# EAGLE schematic Resistor_Resistor (EAGLE 8.3.0), part 31 of 43
## Nets (continued)
N$37: R6001.2 R6002.2 R6003.2 R6004.2 R6005.2 R6006.2 R6007.2 R6008.2 R6009.2 R6010.2 R6011.2 R6012.2 R6013.2 R6014.2 R6015.2 R6016.2 R6017.2 R6018.2 R6019.2 R6020.2 R6021.2 R6022.2 R6023.2 R6024.2 R6025.2 R6026.2 R6027.2 R6028.2 R6029.2 R6030.2 R6031.2 R6032.2 R6033.2 R6034.2 R6035.2 R6036.2 R6037.2 R6038.2 R6039.2 R6040.2 R6041.2 R6042.2 R6043.2 R6044.2 R6045.2 R6046.2 R6047.2 R6048.2 R6049.2 R6050.2 R6051.2 R6052.2 R6053.2 R6054.2 R6055.2 R6056.2 R6057.2 R6058.2 R6059.2 R6060.2 R6061.2 R6062.2 R6063.2 R6064.2 R6065.2 R6066.2 R6067.2 R6068.2 R6069.2 R6070.2 R6071.2 R6072.2 R6073.2 R6074.2 R6075.2 R6076.2 R6077.2 R6078.2 R6079.2 R6080.2 R6081.2 R6082.2 R6083.2 R6084.2 R6085.2 R6086.2 R6087.2 R6088.2 R6089.2 R6090.2 R6091.2 R6092.2 R6093.2 R6094.2 R6095.2 R6096.2 R6097.2 R6098.2 R6099.2 R6100.2 R6101.2 R6102.2 R6103.2 R6104.2 R6105.2 R6106.2 R6107.2 R6108.2 R6109.2 R6110.2 R6111.2 R6112.2 R6113.2 R6114.2 R6115.2 R6116.2 R6117.2 R6118.2 R6119.2 R6120.2 R6121.2 R6122.2 R6123.2 R6124.2 R6125.2 R6126.2 R6127.2 R6128.2 R6129.2 R6130.2 R6131.2 R6132.2 R6133.2 R6134.2 R6135.2 R6136.2 R6137.2 R6138.2 R6139.2 R6140.2 R6141.2 R6142.2 R6143.2 R6144.2 R6145.2 R6146.2 R6147.2 R6148.2 R6149.2 R6150.2 R6151.2 R6152.2 R6153.2 R6154.2 R6155.2 R6156.2 R6157.2 R6158.2 R6159.2 R6160.2 R6161.2 R6162.2 R6163.2 R6164.2 R6165.2 R6166.2 R6167.2 R6168.2 R6169.2 R6170.2 R6171.2 R6172.2 R6173.2 R6174.2 R6175.2 R6176.2 R6177.2 R6178.2 R6179.2 R6180.2 R6181.2 R6182.2 R6183.2 R6184.2 R6185.2 R6186.2 R6187.2 R6188.2 R6189.2 R6190.2 R6191.2 R6192.2 R6193.2 R6194.2 R6195.2 R6196.2 R6197.2 R6198.2 R6199.2 R6200.2 R6201.1 R6202.1 R6203.1 R6204.1 R6205.1 R6206.1 R6207.1 R6208.1 R6209.1 R6210.1 R6211.1 R6212.1 R6213.1 R6214.1 R6215.1 R6216.1 R6217.1 R6218.1 R6219.1 R6220.1 R6221.1 R6222.1 R6223.1 R6224.1 R6225.1 R6226.1 R6227.1 R6228.1 R6229.1 R6230.1 R6231.1 R6232.1 R6233.1 R6234.1 R6235.1 R6236.1 R6237.1 R6238.1 R6239.1 R6240.1 R6241.1 R6242.1 R6243.1 R6244.1 R6245.1 R6246.1 R6247.1 R6248.1 R6249.1 R6250.1 R6251.1 R6252.1 R6253.1 R6254.1 R6255.1 R6256.1 R6257.1 R6258.1 R6259.1 R6260.1 R6261.1 R6262.1 R6263.1 R6264.1 R6265.1 R6266.1 R6267.1 R6268.1 R6269.1 R6270.1 R6271.1 R6272.1 R6273.1 R6274.1 R6275.1 R6276.1 R6277.1 R6278.1 R6279.1 R6280.1 R6281.1 R6282.1 R6283.1 R6284.1 R6285.1 R6286.1 R6287.1 R6288.1 R6289.1 R6290.1 R6291.1 R6292.1 R6293.1 R6294.1 R6295.1 R6296.1 R6297.1 R6298.1 R6299.1 R6300.1 R6301.1 R6302.1 R6303.1 R6304.1 R6305.1 R6306.1 R6307.1 R6308.1 R6309.1 R6310.1 R6311.1 R6312.1 R6313.1 R6314.1 R6315.1 R6316.1 R6317.1 R6318.1 R6319.1 R6320.1 R6321.1 R6322.1 R6323.1 R6324.1 R6325.1 R6326.1 R6327.1 R6328.1 R6329.1 R6330.1 R6331.1 R6332.1 R6333.1 R6334.1 R6335.1 R6336.1 R6337.1 R6338.1 R6339.1 R6340.1 R6341.1 R6342.1 R6343.1 R6344.1 R6345.1 R6346.1 R6347.1 R6348.1 R6349.1 R6350.1 R6351.1 R6352.1 R6353.1 R6354.1 R6355.1 R6356.1 R6357.1 R6358.1 R6359.1 R6360.1 R6361.1 R6362.1 R6363.1 R6364.1 R6365.1 R6366.1 R6367.1 R6368.1 R6369.1 R6370.1 R6371.1 R6372.1 R6373.1 R6374.1 R6375.1 R6376.1 R6377.1 R6378.1 R6379.1 R6380.1 R6381.1 R6382.1 R6383.1 R6384.1 R6385.1 R6386.1 R6387.1 R6388.1 R6389.1 R6390.1 R6391.1 R6392.1 R6393.1 R6394.1 R6395.1 R6396.1 R6397.1 R6398.1 R6399.1 R6400.1
N$38: R6201.2 R6202.2 R6203.2 R6204.2 R6205.2 R6206.2 R6207.2 R6208.2 R6209.2 R6210.2 R6211.2 R6212.2 R6213.2 R6214.2 R6215.2 R6216.2 R6217.2 R6218.2 R6219.2 R6220.2 R6221.2 R6222.2 R6223.2 R6224.2 R6225.2 R6226.2 R6227.2 R6228.2 R6229.2 R6230.2 R6231.2 R6232.2 R6233.2 R6234.2 R6235.2 R6236.2 R6237.2 R6238.2 R6239.2 R6240.2 R6241.2 R6242.2 R6243.2 R6244.2 R6245.2 R6246.2 R6247.2 R6248.2 R6249.2 R6250.2 R6251.2 R6252.2 R6253.2 R6254.2 R6255.2 R6256.2 R6257.2 R6258.2 R6259.2 R6260.2 R6261.2 R6262.2 R6263.2 R6264.2 R6265.2 R6266.2 R6267.2 R6268.2 R6269.2 R6270.2 R6271.2 R6272.2 R6273.2 R6274.2 R6275.2 R6276.2 R6277.2 R6278.2 R6279.2 R6280.2 R6281.2 R6282.2 R6283.2 R6284.2 R6285.2 R6286.2 R6287.2 R6288.2 R6289.2 R6290.2 R6291.2 R6292.2 R6293.2 R6294.2 R6295.2 R6296.2 R6297.2 R6298.2 R6299.2 R6300.2 R6301.2 R6302.2 R6303.2 R6304.2 R6305.2 R6306.2 R6307.2 R6308.2 R6309.2 R6310.2 R6311.2 R6312.2 R6313.2 R6314.2 R6315.2 R6316.2 R6317.2 R6318.2 R6319.2 R6320.2 R6321.2 R6322.2 R6323.2 R6324.2 R6325.2 R6326.2 R6327.2 R6328.2 R6329.2 R6330.2 R6331.2 R6332.2 R6333.2 R6334.2 R6335.2 R6336.2 R6337.2 R6338.2 R6339.2 R6340.2 R6341.2 R6342.2 R6343.2 R6344.2 R6345.2 R6346.2 R6347.2 R6348.2 R6349.2 R6350.2 R6351.2 R6352.2 R6353.2 R6354.2 R6355.2 R6356.2 R6357.2 R6358.2 R6359.2 R6360.2 R6361.2 R6362.2 R6363.2 R6364.2 R6365.2 R6366.2 R6367.2 R6368.2 R6369.2 R6370.2 R6371.2 R6372.2 R6373.2 R6374.2 R6375.2 R6376.2 R6377.2 R6378.2 R6379.2 R6380.2 R6381.2 R6382.2 R6383.2 R6384.2 R6385.2 R6386.2 R6387.2 R6388.2 R6389.2 R6390.2 R6391.2 R6392.2 R6393.2 R6394.2 R6395.2 R6396.2 R6397.2 R6398.2 R6399.2 R6400.2 R6401.1 R6402.1 R6403.1 R6404.1 R6405.1 R6406.1 R6407.1 R6408.1 R6409.1 R6410.1 R6411.1 R6412.1 R6413.1 R6414.1 R6415.1 R6416.1 R6417.1 R6418.1 R6419.1 R6420.1 R6421.1 R6422.1 R6423.1 R6424.1 R6425.1 R6426.1 R6427.1 R6428.1 R6429.1 R6430.1 R6431.1 R6432.1 R6433.1 R6434.1 R6435.1 R6436.1 R6437.1 R6438.1 R6439.1 R6440.1 R6441.1 R6442.1 R6443.1 R6444.1 R6445.1 R6446.1 R6447.1 R6448.1 R6449.1 R6450.1 R6451.1 R6452.1 R6453.1 R6454.1 R6455.1 R6456.1 R6457.1 R6458.1 R6459.1 R6460.1 R6461.1 R6462.1 R6463.1 R6464.1 R6465.1 R6466.1 R6467.1 R6468.1 R6469.1 R6470.1 R6471.1 R6472.1 R6473.1 R6474.1 R6475.1 R6476.1 R6477.1 R6478.1 R6479.1 R6480.1 R6481.1 R6482.1 R6483.1 R6484.1 R6485.1 R6486.1 R6487.1 R6488.1 R6489.1 R6490.1 R6491.1 R6492.1 R6493.1 R6494.1 R6495.1 R6496.1 R6497.1 R6498.1 R6499.1 R6500.1 R6501.1 R6502.1 R6503.1 R6504.1 R6505.1 R6506.1 R6507.1 R6508.1 R6509.1 R6510.1 R6511.1 R6512.1 R6513.1 R6514.1 R6515.1 R6516.1 R6517.1 R6518.1 R6519.1 R6520.1 R6521.1 R6522.1 R6523.1 R6524.1 R6525.1 R6526.1 R6527.1 R6528.1 R6529.1 R6530.1 R6531.1 R6532.1 R6533.1 R6534.1 R6535.1 R6536.1 R6537.1 R6538.1 R6539.1 R6540.1 R6541.1 R6542.1 R6543.1 R6544.1 R6545.1 R6546.1 R6547.1 R6548.1 R6549.1 R6550.1 R6551.1 R6552.1 R6553.1 R6554.1 R6555.1 R6556.1 R6557.1 R6558.1 R6559.1 R6560.1 R6561.1 R6562.1 R6563.1 R6564.1 R6565.1 R6566.1 R6567.1 R6568.1 R6569.1 R6570.1 R6571.1 R6572.1 R6573.1 R6574.1 R6575.1 R6576.1 R6577.1 R6578.1 R6579.1 R6580.1 R6581.1 R6582.1 R6583.1 R6584.1 R6585.1 R6586.1 R6587.1 R6588.1 R6589.1 R6590.1 R6591.1 R6592.1 R6593.1 R6594.1 R6595.1 R6596.1 R6597.1 R6598.1 R6599.1 R6600.1
N$40: R6401.2 R6402.2 R6403.2 R6404.2 R6405.2 R6406.2 R6407.2 R6408.2 R6409.2 R6410.2 R6411.2 R6412.2 R6413.2 R6414.2 R6415.2 R6416.2 R6417.2 R6418.2 R6419.2 R6420.2 R6421.2 R6422.2 R6423.2 R6424.2 R6425.2 R6426.2 R6427.2 R6428.2 R6429.2 R6430.2 R6431.2 R6432.2 R6433.2 R6434.2 R6435.2 R6436.2 R6437.2 R6438.2 R6439.2 R6440.2 R6441.2 R6442.2 R6443.2 R6444.2 R6445.2 R6446.2 R6447.2 R6448.2 R6449.2 R6450.2 R6451.2 R6452.2 R6453.2 R6454.2 R6455.2 R6456.2 R6457.2 R6458.2 R6459.2 R6460.2 R6461.2 R6462.2 R6463.2 R6464.2 R6465.2 R6466.2 R6467.2 R6468.2 R6469.2 R6470.2 R6471.2 R6472.2 R6473.2 R6474.2 R6475.2 R6476.2 R6477.2 R6478.2 R6479.2 R6480.2 R6481.2 R6482.2 R6483.2 R6484.2 R6485.2 R6486.2 R6487.2 R6488.2 R6489.2 R6490.2 R6491.2 R6492.2 R6493.2 R6494.2 R6495.2 R6496.2 R6497.2 R6498.2 R6499.2 R6500.2 R6501.2 R6502.2 R6503.2 R6504.2 R6505.2 R6506.2 R6507.2 R6508.2 R6509.2 R6510.2 R6511.2 R6512.2 R6513.2 R6514.2 R6515.2 R6516.2 R6517.2 R6518.2 R6519.2 R6520.2 R6521.2 R6522.2 R6523.2 R6524.2 R6525.2 R6526.2 R6527.2 R6528.2 R6529.2 R6530.2 R6531.2 R6532.2 R6533.2 R6534.2 R6535.2 R6536.2 R6537.2 R6538.2 R6539.2 R6540.2 R6541.2 R6542.2 R6543.2 R6544.2 R6545.2 R6546.2 R6547.2 R6548.2 R6549.2 R6550.2 R6551.2 R6552.2 R6553.2 R6554.2 R6555.2 R6556.2 R6557.2 R6558.2 R6559.2 R6560.2 R6561.2 R6562.2 R6563.2 R6564.2 R6565.2 R6566.2 R6567.2 R6568.2 R6569.2 R6570.2 R6571.2 R6572.2 R6573.2 R6574.2 R6575.2 R6576.2 R6577.2 R6578.2 R6579.2 R6580.2 R6581.2 R6582.2 R6583.2 R6584.2 R6585.2 R6586.2 R6587.2 R6588.2 R6589.2 R6590.2 R6591.2 R6592.2 R6593.2 R6594.2 R6595.2 R6596.2 R6597.2 R6598.2 R6599.2 R6600.2 R6601.1 R6602.1 R6603.1 R6604.1 R6605.1 R6606.1 R6607.1 R6608.1 R6609.1 R6610.1 R6611.1 R6612.1 R6613.1 R6614.1 R6615.1 R6616.1 R6617.1 R6618.1 R6619.1 R6620.1 R6621.1 R6622.1 R6623.1 R6624.1 R6625.1 R6626.1 R6627.1 R6628.1 R6629.1 R6630.1 R6631.1 R6632.1 R6633.1 R6634.1 R6635.1 R6636.1 R6637.1 R6638.1 R6639.1 R6640.1 R6641.1 R6642.1 R6643.1 R6644.1 R6645.1 R6646.1 R6647.1 R6648.1 R6649.1 R6650.1 R6651.1 R6652.1 R6653.1 R6654.1 R6655.1 R6656.1 R6657.1 R6658.1 R6659.1 R6660.1 R6661.1 R6662.1 R6663.1 R6664.1 R6665.1 R6666.1 R6667.1 R6668.1 R6669.1 R6670.1 R6671.1 R6672.1 R6673.1 R6674.1 R6675.1 R6676.1 R6677.1 R6678.1 R6679.1 R6680.1 R6681.1 R6682.1 R6683.1 R6684.1 R6685.1 R6686.1 R6687.1 R6688.1 R6689.1 R6690.1 R6691.1 R6692.1 R6693.1 R6694.1 R6695.1 R6696.1 R6697.1 R6698.1 R6699.1 R6700.1 R6701.1 R6702.1 R6703.1 R6704.1 R6705.1 R6706.1 R6707.1 R6708.1 R6709.1 R6710.1 R6711.1 R6712.1 R6713.1 R6714.1 R6715.1 R6716.1 R6717.1 R6718.1 R6719.1 R6720.1 R6721.1 R6722.1 R6723.1 R6724.1 R6725.1 R6726.1 R6727.1 R6728.1 R6729.1 R6730.1 R6731.1 R6732.1 R6733.1 R6734.1 R6735.1 R6736.1 R6737.1 R6738.1 R6739.1 R6740.1 R6741.1 R6742.1 R6743.1 R6744.1 R6745.1 R6746.1 R6747.1 R6748.1 R6749.1 R6750.1 R6751.1 R6752.1 R6753.1 R6754.1 R6755.1 R6756.1 R6757.1 R6758.1 R6759.1 R6760.1 R6761.1 R6762.1 R6763.1 R6764.1 R6765.1 R6766.1 R6767.1 R6768.1 R6769.1 R6770.1 R6771.1 R6772.1 R6773.1 R6774.1 R6775.1 R6776.1 R6777.1 R6778.1 R6779.1 R6780.1 R6781.1 R6782.1 R6783.1 R6784.1 R6785.1 R6786.1 R6787.1 R6788.1 R6789.1 R6790.1 R6791.1 R6792.1 R6793.1 R6794.1 R6795.1 R6796.1 R6797.1 R6798.1 R6799.1 R6800.1
N$41: R6601.2 R6602.2 R6603.2 R6604.2 R6605.2 R6606.2 R6607.2 R6608.2 R6609.2 R6610.2 R6611.2 R6612.2 R6613.2 R6614.2 R6615.2 R6616.2 R6617.2 R6618.2 R6619.2 R6620.2 R6621.2 R6622.2 R6623.2 R6624.2 R6625.2 R6626.2 R6627.2 R6628.2 R6629.2 R6630.2 R6631.2 R6632.2 R6633.2 R6634.2 R6635.2 R6636.2 R6637.2 R6638.2 R6639.2 R6640.2 R6641.2 R6642.2 R6643.2 R6644.2 R6645.2 R6646.2 R6647.2 R6648.2 R6649.2 R6650.2 R6651.2 R6652.2 R6653.2 R6654.2 R6655.2 R6656.2 R6657.2 R6658.2 R6659.2 R6660.2 R6661.2 R6662.2 R6663.2 R6664.2 R6665.2 R6666.2 R6667.2 R6668.2 R6669.2 R6670.2 R6671.2 R6672.2 R6673.2 R6674.2 R6675.2 R6676.2 R6677.2 R6678.2 R6679.2 R6680.2 R6681.2 R6682.2 R6683.2 R6684.2 R6685.2 R6686.2 R6687.2 R6688.2 R6689.2 R6690.2 R6691.2 R6692.2 R6693.2 R6694.2 R6695.2 R6696.2 R6697.2 R6698.2 R6699.2 R6700.2 R6701.2 R6702.2 R6703.2 R6704.2 R6705.2 R6706.2 R6707.2 R6708.2 R6709.2 R6710.2 R6711.2 R6712.2 R6713.2 R6714.2 R6715.2 R6716.2 R6717.2 R6718.2 R6719.2 R6720.2 R6721.2 R6722.2 R6723.2 R6724.2 R6725.2 R6726.2 R6727.2 R6728.2 R6729.2 R6730.2 R6731.2 R6732.2 R6733.2 R6734.2 R6735.2 R6736.2 R6737.2 R6738.2 R6739.2 R6740.2 R6741.2 R6742.2 R6743.2 R6744.2 R6745.2 R6746.2 R6747.2 R6748.2 R6749.2 R6750.2 R6751.2 R6752.2 R6753.2 R6754.2 R6755.2 R6756.2 R6757.2 R6758.2 R6759.2 R6760.2 R6761.2 R6762.2 R6763.2 R6764.2 R6765.2 R6766.2 R6767.2 R6768.2 R6769.2 R6770.2 R6771.2 R6772.2 R6773.2 R6774.2 R6775.2 R6776.2 R6777.2 R6778.2 R6779.2 R6780.2 R6781.2 R6782.2 R6783.2 R6784.2 R6785.2 R6786.2 R6787.2 R6788.2 R6789.2 R6790.2 R6791.2 R6792.2 R6793.2 R6794.2 R6795.2 R6796.2 R6797.2 R6798.2 R6799.2 R6800.2 R6801.1 R6802.1 R6803.1 R6804.1 R6805.1 R6806.1 R6807.1 R6808.1 R6809.1 R6810.1 R6811.1 R6812.1 R6813.1 R6814.1 R6815.1 R6816.1 R6817.1 R6818.1 R6819.1 R6820.1 R6821.1 R6822.1 R6823.1 R6824.1 R6825.1 R6826.1 R6827.1 R6828.1 R6829.1 R6830.1 R6831.1 R6832.1 R6833.1 R6834.1 R6835.1 R6836.1 R6837.1 R6838.1 R6839.1 R6840.1 R6841.1 R6842.1 R6843.1 R6844.1 R6845.1 R6846.1 R6847.1 R6848.1 R6849.1 R6850.1 R6851.1 R6852.1 R6853.1 R6854.1 R6855.1 R6856.1 R6857.1 R6858.1 R6859.1 R6860.1 R6861.1 R6862.1 R6863.1 R6864.1 R6865.1 R6866.1 R6867.1 R6868.1 R6869.1 R6870.1 R6871.1 R6872.1 R6873.1 R6874.1 R6875.1 R6876.1 R6877.1 R6878.1 R6879.1 R6880.1 R6881.1 R6882.1 R6883.1 R6884.1 R6885.1 R6886.1 R6887.1 R6888.1 R6889.1 R6890.1 R6891.1 R6892.1 R6893.1 R6894.1 R6895.1 R6896.1 R6897.1 R6898.1 R6899.1 R6900.1 R6901.1 R6902.1 R6903.1 R6904.1 R6905.1 R6906.1 R6907.1 R6908.1 R6909.1 R6910.1 R6911.1 R6912.1 R6913.1 R6914.1 R6915.1 R6916.1 R6917.1 R6918.1 R6919.1 R6920.1 R6921.1 R6922.1 R6923.1 R6924.1 R6925.1 R6926.1 R6927.1 R6928.1 R6929.1 R6930.1 R6931.1 R6932.1 R6933.1 R6934.1 R6935.1 R6936.1 R6937.1 R6938.1 R6939.1 R6940.1 R6941.1 R6942.1 R6943.1 R6944.1 R6945.1 R6946.1 R6947.1 R6948.1 R6949.1 R6950.1 R6951.1 R6952.1 R6953.1 R6954.1 R6955.1 R6956.1 R6957.1 R6958.1 R6959.1 R6960.1 R6961.1 R6962.1 R6963.1 R6964.1 R6965.1 R6966.1 R6967.1 R6968.1 R6969.1 R6970.1 R6971.1 R6972.1 R6973.1 R6974.1 R6975.1 R6976.1 R6977.1 R6978.1 R6979.1 R6980.1 R6981.1 R6982.1 R6983.1 R6984.1 R6985.1 R6986.1 R6987.1 R6988.1 R6989.1 R6990.1 R6991.1 R6992.1 R6993.1 R6994.1 R6995.1 R6996.1 R6997.1 R6998.1 R6999.1 R7000.1
N$42: R6801.2 R6802.2 R6803.2 R6804.2 R6805.2 R6806.2 R6807.2 R6808.2 R6809.2 R6810.2 R6811.2 R6812.2 R6813.2 R6814.2 R6815.2 R6816.2 R6817.2 R6818.2 R6819.2 R6820.2 R6821.2 R6822.2 R6823.2 R6824.2 R6825.2 R6826.2 R6827.2 R6828.2 R6829.2 R6830.2 R6831.2 R6832.2 R6833.2 R6834.2 R6835.2 R6836.2 R6837.2 R6838.2 R6839.2 R6840.2 R6841.2 R6842.2 R6843.2 R6844.2 R6845.2 R6846.2 R6847.2 R6848.2 R6849.2 R6850.2 R6851.2 R6852.2 R6853.2 R6854.2 R6855.2 R6856.2 R6857.2 R6858.2 R6859.2 R6860.2 R6861.2 R6862.2 R6863.2 R6864.2 R6865.2 R6866.2 R6867.2 R6868.2 R6869.2 R6870.2 R6871.2 R6872.2 R6873.2 R6874.2 R6875.2 R6876.2 R6877.2 R6878.2 R6879.2 R6880.2 R6881.2 R6882.2 R6883.2 R6884.2 R6885.2 R6886.2 R6887.2 R6888.2 R6889.2 R6890.2 R6891.2 R6892.2 R6893.2 R6894.2 R6895.2 R6896.2 R6897.2 R6898.2 R6899.2 R6900.2 R6901.2 R6902.2 R6903.2 R6904.2 R6905.2 R6906.2 R6907.2 R6908.2 R6909.2 R6910.2 R6911.2 R6912.2 R6913.2 R6914.2 R6915.2 R6916.2 R6917.2 R6918.2 R6919.2 R6920.2 R6921.2 R6922.2 R6923.2 R6924.2 R6925.2 R6926.2 R6927.2 R6928.2 R6929.2 R6930.2 R6931.2 R6932.2 R6933.2 R6934.2 R6935.2 R6936.2 R6937.2 R6938.2 R6939.2 R6940.2 R6941.2 R6942.2 R6943.2 R6944.2 R6945.2 R6946.2 R6947.2 R6948.2 R6949.2 R6950.2 R6951.2 R6952.2 R6953.2 R6954.2 R6955.2 R6956.2 R6957.2 R6958.2 R6959.2 R6960.2 R6961.2 R6962.2 R6963.2 R6964.2 R6965.2 R6966.2 R6967.2 R6968.2 R6969.2 R6970.2 R6971.2 R6972.2 R6973.2 R6974.2 R6975.2 R6976.2 R6977.2 R6978.2 R6979.2 R6980.2 R6981.2 R6982.2 R6983.2 R6984.2 R6985.2 R6986.2 R6987.2 R6988.2 R6989.2 R6990.2 R6991.2 R6992.2 R6993.2 R6994.2 R6995.2 R6996.2 R6997.2 R6998.2 R6999.2 R7000.2 R7001.1 R7002.1 R7003.1 R7004.1 R7005.1 R7006.1 R7007.1 R7008.1 R7009.1 R7010.1 R7011.1 R7012.1 R7013.1 R7014.1 R7015.1 R7016.1 R7017.1 R7018.1 R7019.1 R7020.1 R7021.1 R7022.1 R7023.1 R7024.1 R7025.1 R7026.1 R7027.1 R7028.1 R7029.1 R7030.1 R7031.1 R7032.1 R7033.1 R7034.1 R7035.1 R7036.1 R7037.1 R7038.1 R7039.1 R7040.1 R7041.1 R7042.1 R7043.1 R7044.1 R7045.1 R7046.1 R7047.1 R7048.1 R7049.1 R7050.1 R7051.1 R7052.1 R7053.1 R7054.1 R7055.1 R7056.1 R7057.1 R7058.1 R7059.1 R7060.1 R7061.1 R7062.1 R7063.1 R7064.1 R7065.1 R7066.1 R7067.1 R7068.1 R7069.1 R7070.1 R7071.1 R7072.1 R7073.1 R7074.1 R7075.1 R7076.1 R7077.1 R7078.1 R7079.1 R7080.1 R7081.1 R7082.1 R7083.1 R7084.1 R7085.1 R7086.1 R7087.1 R7088.1 R7089.1 R7090.1 R7091.1 R7092.1 R7093.1 R7094.1 R7095.1 R7096.1 R7097.1 R7098.1 R7099.1 R7100.1 R7101.1 R7102.1 R7103.1 R7104.1 R7105.1 R7106.1 R7107.1 R7108.1 R7109.1 R7110.1 R7111.1 R7112.1 R7113.1 R7114.1 R7115.1 R7116.1 R7117.1 R7118.1 R7119.1 R7120.1 R7121.1 R7122.1 R7123.1 R7124.1 R7125.1 R7126.1 R7127.1 R7128.1 R7129.1 R7130.1 R7131.1 R7132.1 R7133.1 R7134.1 R7135.1 R7136.1 R7137.1 R7138.1 R7139.1 R7140.1 R7141.1 R7142.1 R7143.1 R7144.1 R7145.1 R7146.1 R7147.1 R7148.1 R7149.1 R7150.1 R7151.1 R7152.1 R7153.1 R7154.1 R7155.1 R7156.1 R7157.1 R7158.1 R7159.1 R7160.1 R7161.1 R7162.1 R7163.1 R7164.1 R7165.1 R7166.1 R7167.1 R7168.1 R7169.1 R7170.1 R7171.1 R7172.1 R7173.1 R7174.1 R7175.1 R7176.1 R7177.1 R7178.1 R7179.1 R7180.1 R7181.1 R7182.1 R7183.1 R7184.1 R7185.1 R7186.1 R7187.1 R7188.1 R7189.1 R7190.1 R7191.1 R7192.1 R7193.1 R7194.1 R7195.1 R7196.1 R7197.1 R7198.1 R7199.1 R7200.1
N$43: R7001.2 R7002.2 R7003.2 R7004.2 R7005.2 R7006.2 R7007.2 R7008.2 R7009.2 R7010.2 R7011.2 R7012.2 R7013.2 R7014.2 R7015.2 R7016.2 R7017.2 R7018.2 R7019.2 R7020.2 R7021.2 R7022.2 R7023.2 R7024.2 R7025.2 R7026.2 R7027.2 R7028.2 R7029.2 R7030.2 R7031.2 R7032.2 R7033.2 R7034.2 R7035.2 R7036.2 R7037.2 R7038.2 R7039.2 R7040.2 R7041.2 R7042.2 R7043.2 R7044.2 R7045.2 R7046.2 R7047.2 R7048.2 R7049.2 R7050.2 R7051.2 R7052.2 R7053.2 R7054.2 R7055.2 R7056.2 R7057.2 R7058.2 R7059.2 R7060.2 R7061.2 R7062.2 R7063.2 R7064.2 R7065.2 R7066.2 R7067.2 R7068.2 R7069.2 R7070.2 R7071.2 R7072.2 R7073.2 R7074.2 R7075.2 R7076.2 R7077.2 R7078.2 R7079.2 R7080.2 R7081.2 R7082.2 R7083.2 R7084.2 R7085.2 R7086.2 R7087.2 R7088.2 R7089.2 R7090.2 R7091.2 R7092.2 R7093.2 R7094.2 R7095.2 R7096.2 R7097.2 R7098.2 R7099.2 R7100.2 R7101.2 R7102.2 R7103.2 R7104.2 R7105.2 R7106.2 R7107.2 R7108.2 R7109.2 R7110.2 R7111.2 R7112.2 R7113.2 R7114.2 R7115.2 R7116.2 R7117.2 R7118.2 R7119.2 R7120.2 R7121.2 R7122.2 R7123.2 R7124.2 R7125.2 R7126.2 R7127.2 R7128.2 R7129.2 R7130.2 R7131.2 R7132.2 R7133.2 R7134.2 R7135.2 R7136.2 R7137.2 R7138.2 R7139.2 R7140.2 R7141.2 R7142.2 R7143.2 R7144.2 R7145.2 R7146.2 R7147.2 R7148.2 R7149.2 R7150.2 R7151.2 R7152.2 R7153.2 R7154.2 R7155.2 R7156.2 R7157.2 R7158.2 R7159.2 R7160.2 R7161.2 R7162.2 R7163.2 R7164.2 R7165.2 R7166.2 R7167.2 R7168.2 R7169.2 R7170.2 R7171.2 R7172.2 R7173.2 R7174.2 R7175.2 R7176.2 R7177.2 R7178.2 R7179.2 R7180.2 R7181.2 R7182.2 R7183.2 R7184.2 R7185.2 R7186.2 R7187.2 R7188.2 R7189.2 R7190.2 R7191.2 R7192.2 R7193.2 R7194.2 R7195.2 R7196.2 R7197.2 R7198.2 R7199.2 R7200.2 R7201.1 R7202.1 R7203.1 R7204.1 R7205.1 R7206.1 R7207.1 R7208.1 R7209.1 R7210.1 R7211.1 R7212.1 R7213.1 R7214.1 R7215.1 R7216.1 R7217.1 R7218.1 R7219.1 R7220.1 R7221.1 R7222.1 R7223.1 R7224.1 R7225.1 R7226.1 R7227.1 R7228.1 R7229.1 R7230.1 R7231.1 R7232.1 R7233.1 R7234.1 R7235.1 R7236.1 R7237.1 R7238.1 R7239.1 R7240.1 R7241.1 R7242.1 R7243.1 R7244.1 R7245.1 R7246.1 R7247.1 R7248.1 R7249.1 R7250.1 R7251.1 R7252.1 R7253.1 R7254.1 R7255.1 R7256.1 R7257.1 R7258.1 R7259.1 R7260.1 R7261.1 R7262.1 R7263.1 R7264.1 R7265.1 R7266.1 R7267.1 R7268.1 R7269.1 R7270.1 R7271.1 R7272.1 R7273.1 R7274.1 R7275.1 R7276.1 R7277.1 R7278.1 R7279.1 R7280.1 R7281.1 R7282.1 R7283.1 R7284.1 R7285.1 R7286.1 R7287.1 R7288.1 R7289.1 R7290.1 R7291.1 R7292.1 R7293.1 R7294.1 R7295.1 R7296.1 R7297.1 R7298.1 R7299.1 R7300.1 R7301.1 R7302.1 R7303.1 R7304.1 R7305.1 R7306.1 R7307.1 R7308.1 R7309.1 R7310.1 R7311.1 R7312.1 R7313.1 R7314.1 R7315.1 R7316.1 R7317.1 R7318.1 R7319.1 R7320.1 R7321.1 R7322.1 R7323.1 R7324.1 R7325.1 R7326.1 R7327.1 R7328.1 R7329.1 R7330.1 R7331.1 R7332.1 R7333.1 R7334.1 R7335.1 R7336.1 R7337.1 R7338.1 R7339.1 R7340.1 R7341.1 R7342.1 R7343.1 R7344.1 R7345.1 R7346.1 R7347.1 R7348.1 R7349.1 R7350.1 R7351.1 R7352.1 R7353.1 R7354.1 R7355.1 R7356.1 R7357.1 R7358.1 R7359.1 R7360.1 R7361.1 R7362.1 R7363.1 R7364.1 R7365.1 R7366.1 R7367.1 R7368.1 R7369.1 R7370.1 R7371.1 R7372.1 R7373.1 R7374.1 R7375.1 R7376.1 R7377.1 R7378.1 R7379.1 R7380.1 R7381.1 R7382.1 R7383.1 R7384.1 R7385.1 R7386.1 R7387.1 R7388.1 R7389.1 R7390.1 R7391.1 R7392.1 R7393.1 R7394.1 R7395.1 R7396.1 R7397.1 R7398.1 R7399.1 R7400.1
N$44: R7201.2 R7202.2 R7203.2 R7204.2 R7205.2 R7206.2 R7207.2 R7208.2 R7209.2 R7210.2 R7211.2 R7212.2 R7213.2 R7214.2 R7215.2 R7216.2 R7217.2 R7218.2 R7219.2 R7220.2 R7221.2 R7222.2 R7223.2 R7224.2 R7225.2 R7226.2 R7227.2 R7228.2 R7229.2 R7230.2 R7231.2 R7232.2 R7233.2 R7234.2 R7235.2 R7236.2 R7237.2 R7238.2 R7239.2 R7240.2 R7241.2 R7242.2 R7243.2 R7244.2 R7245.2 R7246.2 R7247.2 R7248.2 R7249.2 R7250.2 R7251.2 R7252.2 R7253.2 R7254.2 R7255.2 R7256.2 R7257.2 R7258.2 R7259.2 R7260.2 R7261.2 R7262.2 R7263.2 R7264.2 R7265.2 R7266.2 R7267.2 R7268.2 R7269.2 R7270.2 R7271.2 R7272.2 R7273.2 R7274.2 R7275.2 R7276.2 R7277.2 R7278.2 R7279.2 R7280.2 R7281.2 R7282.2 R7283.2 R7284.2 R7285.2 R7286.2 R7287.2 R7288.2 R7289.2 R7290.2 R7291.2 R7292.2 R7293.2 R7294.2 R7295.2 R7296.2 R7297.2 R7298.2 R7299.2 R7300.2 R7301.2 R7302.2 R7303.2 R7304.2 R7305.2 R7306.2 R7307.2 R7308.2 R7309.2 R7310.2 R7311.2 R7312.2 R7313.2 R7314.2 R7315.2 R7316.2 R7317.2 R7318.2 R7319.2 R7320.2 R7321.2 R7322.2 R7323.2 R7324.2 R7325.2 R7326.2 R7327.2 R7328.2 R7329.2 R7330.2 R7331.2 R7332.2 R7333.2 R7334.2 R7335.2 R7336.2 R7337.2 R7338.2 R7339.2 R7340.2 R7341.2 R7342.2 R7343.2 R7344.2 R7345.2 R7346.2 R7347.2 R7348.2 R7349.2 R7350.2 R7351.2 R7352.2 R7353.2 R7354.2 R7355.2 R7356.2 R7357.2 R7358.2 R7359.2 R7360.2 R7361.2 R7362.2 R7363.2 R7364.2 R7365.2 R7366.2 R7367.2 R7368.2 R7369.2 R7370.2 R7371.2 R7372.2 R7373.2 R7374.2 R7375.2 R7376.2 R7377.2 R7378.2 R7379.2 R7380.2 R7381.2 R7382.2 R7383.2 R7384.2 R7385.2 R7386.2 R7387.2 R7388.2 R7389.2 R7390.2 R7391.2 R7392.2 R7393.2 R7394.2 R7395.2 R7396.2 R7397.2 R7398.2 R7399.2 R7400.2 R7401.1 R7402.1 R7403.1 R7404.1 R7405.1 R7406.1 R7407.1 R7408.1 R7409.1 R7410.1 R7411.1 R7412.1 R7413.1 R7414.1 R7415.1 R7416.1 R7417.1 R7418.1 R7419.1 R7420.1 R7421.1 R7422.1 R7423.1 R7424.1 R7425.1 R7426.1 R7427.1 R7428.1 R7429.1 R7430.1 R7431.1 R7432.1 R7433.1 R7434.1 R7435.1 R7436.1 R7437.1 R7438.1 R7439.1 R7440.1 R7441.1 R7442.1 R7443.1 R7444.1 R7445.1 R7446.1 R7447.1 R7448.1 R7449.1 R7450.1 R7451.1 R7452.1 R7453.1 R7454.1 R7455.1 R7456.1 R7457.1 R7458.1 R7459.1 R7460.1 R7461.1 R7462.1 R7463.1 R7464.1 R7465.1 R7466.1 R7467.1 R7468.1 R7469.1 R7470.1 R7471.1 R7472.1 R7473.1 R7474.1 R7475.1 R7476.1 R7477.1 R7478.1 R7479.1 R7480.1 R7481.1 R7482.1 R7483.1 R7484.1 R7485.1 R7486.1 R7487.1 R7488.1 R7489.1 R7490.1 R7491.1 R7492.1 R7493.1 R7494.1 R7495.1 R7496.1 R7497.1 R7498.1 R7499.1 R7500.1 R7501.1 R7502.1 R7503.1 R7504.1 R7505.1 R7506.1 R7507.1 R7508.1 R7509.1 R7510.1 R7511.1 R7512.1 R7513.1 R7514.1 R7515.1 R7516.1 R7517.1 R7518.1 R7519.1 R7520.1 R7521.1 R7522.1 R7523.1 R7524.1 R7525.1 R7526.1 R7527.1 R7528.1 R7529.1 R7530.1 R7531.1 R7532.1 R7533.1 R7534.1 R7535.1 R7536.1 R7537.1 R7538.1 R7539.1 R7540.1 R7541.1 R7542.1 R7543.1 R7544.1 R7545.1 R7546.1 R7547.1 R7548.1 R7549.1 R7550.1 R7551.1 R7552.1 R7553.1 R7554.1 R7555.1 R7556.1 R7557.1 R7558.1 R7559.1 R7560.1 R7561.1 R7562.1 R7563.1 R7564.1 R7565.1 R7566.1 R7567.1 R7568.1 R7569.1 R7570.1 R7571.1 R7572.1 R7573.1 R7574.1 R7575.1 R7576.1 R7577.1 R7578.1 R7579.1 R7580.1 R7581.1 R7582.1 R7583.1 R7584.1 R7585.1 R7586.1 R7587.1 R7588.1 R7589.1 R7590.1 R7591.1 R7592.1 R7593.1 R7594.1 R7595.1 R7596.1 R7597.1 R7598.1 R7599.1 R7600.1
N$45: R7401.2 R7402.2 R7403.2 R7404.2 R7405.2 R7406.2 R7407.2 R7408.2 R7409.2 R7410.2 R7411.2 R7412.2 R7413.2 R7414.2 R7415.2 R7416.2 R7417.2 R7418.2 R7419.2 R7420.2 R7421.2 R7422.2 R7423.2 R7424.2 R7425.2 R7426.2 R7427.2 R7428.2 R7429.2 R7430.2 R7431.2 R7432.2 R7433.2 R7434.2 R7435.2 R7436.2 R7437.2 R7438.2 R7439.2 R7440.2 R7441.2 R7442.2 R7443.2 R7444.2 R7445.2 R7446.2 R7447.2 R7448.2 R7449.2 R7450.2 R7451.2 R7452.2 R7453.2 R7454.2 R7455.2 R7456.2 R7457.2 R7458.2 R7459.2 R7460.2 R7461.2 R7462.2 R7463.2 R7464.2 R7465.2 R7466.2 R7467.2 R7468.2 R7469.2 R7470.2 R7471.2 R7472.2 R7473.2 R7474.2 R7475.2 R7476.2 R7477.2 R7478.2 R7479.2 R7480.2 R7481.2 R7482.2 R7483.2 R7484.2 R7485.2 R7486.2 R7487.2 R7488.2 R7489.2 R7490.2 R7491.2 R7492.2 R7493.2 R7494.2 R7495.2 R7496.2 R7497.2 R7498.2 R7499.2 R7500.2 R7501.2 R7502.2 R7503.2 R7504.2 R7505.2 R7506.2 R7507.2 R7508.2 R7509.2 R7510.2 R7511.2 R7512.2 R7513.2 R7514.2 R7515.2 R7516.2 R7517.2 R7518.2 R7519.2 R7520.2 R7521.2 R7522.2 R7523.2 R7524.2 R7525.2 R7526.2 R7527.2 R7528.2 R7529.2 R7530.2 R7531.2 R7532.2 R7533.2 R7534.2 R7535.2 R7536.2 R7537.2 R7538.2 R7539.2 R7540.2 R7541.2 R7542.2 R7543.2 R7544.2 R7545.2 R7546.2 R7547.2 R7548.2 R7549.2 R7550.2 R7551.2 R7552.2 R7553.2 R7554.2 R7555.2 R7556.2 R7557.2 R7558.2 R7559.2 R7560.2 R7561.2 R7562.2 R7563.2 R7564.2 R7565.2 R7566.2 R7567.2 R7568.2 R7569.2 R7570.2 R7571.2 R7572.2 R7573.2 R7574.2 R7575.2 R7576.2 R7577.2 R7578.2 R7579.2 R7580.2 R7581.2 R7582.2 R7583.2 R7584.2 R7585.2 R7586.2 R7587.2 R7588.2 R7589.2 R7590.2 R7591.2 R7592.2 R7593.2 R7594.2 R7595.2 R7596.2 R7597.2 R7598.2 R7599.2 R7600.2 R7601.1 R7602.1 R7603.1 R7604.1 R7605.1 R7606.1 R7607.1 R7608.1 R7609.1 R7610.1 R7611.1 R7612.1 R7613.1 R7614.1 R7615.1 R7616.1 R7617.1 R7618.1 R7619.1 R7620.1 R7621.1 R7622.1 R7623.1 R7624.1 R7625.1 R7626.1 R7627.1 R7628.1 R7629.1 R7630.1 R7631.1 R7632.1 R7633.1 R7634.1 R7635.1 R7636.1 R7637.1 R7638.1 R7639.1 R7640.1 R7641.1 R7642.1 R7643.1 R7644.1 R7645.1 R7646.1 R7647.1 R7648.1 R7649.1 R7650.1 R7651.1 R7652.1 R7653.1 R7654.1 R7655.1 R7656.1 R7657.1 R7658.1 R7659.1 R7660.1 R7661.1 R7662.1 R7663.1 R7664.1 R7665.1 R7666.1 R7667.1 R7668.1 R7669.1 R7670.1 R7671.1 R7672.1 R7673.1 R7674.1 R7675.1 R7676.1 R7677.1 R7678.1 R7679.1 R7680.1 R7681.1 R7682.1 R7683.1 R7684.1 R7685.1 R7686.1 R7687.1 R7688.1 R7689.1 R7690.1 R7691.1 R7692.1 R7693.1 R7694.1 R7695.1 R7696.1 R7697.1 R7698.1 R7699.1 R7700.1 R7701.1 R7702.1 R7703.1 R7704.1 R7705.1 R7706.1 R7707.1 R7708.1 R7709.1 R7710.1 R7711.1 R7712.1 R7713.1 R7714.1 R7715.1 R7716.1 R7717.1 R7718.1 R7719.1 R7720.1 R7721.1 R7722.1 R7723.1 R7724.1 R7725.1 R7726.1 R7727.1 R7728.1 R7729.1 R7730.1 R7731.1 R7732.1 R7733.1 R7734.1 R7735.1 R7736.1 R7737.1 R7738.1 R7739.1 R7740.1 R7741.1 R7742.1 R7743.1 R7744.1 R7745.1 R7746.1 R7747.1 R7748.1 R7749.1 R7750.1 R7751.1 R7752.1 R7753.1 R7754.1 R7755.1 R7756.1 R7757.1 R7758.1 R7759.1 R7760.1 R7761.1 R7762.1 R7763.1 R7764.1 R7765.1 R7766.1 R7767.1 R7768.1 R7769.1 R7770.1 R7771.1 R7772.1 R7773.1 R7774.1 R7775.1 R7776.1 R7777.1 R7778.1 R7779.1 R7780.1 R7781.1 R7782.1 R7783.1 R7784.1 R7785.1 R7786.1 R7787.1 R7788.1 R7789.1 R7790.1 R7791.1 R7792.1 R7793.1 R7794.1 R7795.1 R7796.1 R7797.1 R7798.1 R7799.1 R7800.1